# EAGLE schematic Resistor_Resistor (EAGLE 8.3.0), part 32 of 43
## Nets (continued)
N$53: R9001.2 R9002.2 R9003.2 R9004.2 R9005.2 R9006.2 R9007.2 R9008.2 R9009.2 R9010.2 R9011.2 R9012.2 R9013.2 R9014.2 R9015.2 R9016.2 R9017.2 R9018.2 R9019.2 R9020.2 R9021.2 R9022.2 R9023.2 R9024.2 R9025.2 R9026.2 R9027.2 R9028.2 R9029.2 R9030.2 R9031.2 R9032.2 R9033.2 R9034.2 R9035.2 R9036.2 R9037.2 R9038.2 R9039.2 R9040.2 R9041.2 R9042.2 R9043.2 R9044.2 R9045.2 R9046.2 R9047.2 R9048.2 R9049.2 R9050.2 R9051.2 R9052.2 R9053.2 R9054.2 R9055.2 R9056.2 R9057.2 R9058.2 R9059.2 R9060.2 R9061.2 R9062.2 R9063.2 R9064.2 R9065.2 R9066.2 R9067.2 R9068.2 R9069.2 R9070.2 R9071.2 R9072.2 R9073.2 R9074.2 R9075.2 R9076.2 R9077.2 R9078.2 R9079.2 R9080.2 R9081.2 R9082.2 R9083.2 R9084.2 R9085.2 R9086.2 R9087.2 R9088.2 R9089.2 R9090.2 R9091.2 R9092.2 R9093.2 R9094.2 R9095.2 R9096.2 R9097.2 R9098.2 R9099.2 R9100.2 R9101.2 R9102.2 R9103.2 R9104.2 R9105.2 R9106.2 R9107.2 R9108.2 R9109.2 R9110.2 R9111.2 R9112.2 R9113.2 R9114.2 R9115.2 R9116.2 R9117.2 R9118.2 R9119.2 R9120.2 R9121.2 R9122.2 R9123.2 R9124.2 R9125.2 R9126.2 R9127.2 R9128.2 R9129.2 R9130.2 R9131.2 R9132.2 R9133.2 R9134.2 R9135.2 R9136.2 R9137.2 R9138.2 R9139.2 R9140.2 R9141.2 R9142.2 R9143.2 R9144.2 R9145.2 R9146.2 R9147.2 R9148.2 R9149.2 R9150.2 R9151.2 R9152.2 R9153.2 R9154.2 R9155.2 R9156.2 R9157.2 R9158.2 R9159.2 R9160.2 R9161.2 R9162.2 R9163.2 R9164.2 R9165.2 R9166.2 R9167.2 R9168.2 R9169.2 R9170.2 R9171.2 R9172.2 R9173.2 R9174.2 R9175.2 R9176.2 R9177.2 R9178.2 R9179.2 R9180.2 R9181.2 R9182.2 R9183.2 R9184.2 R9185.2 R9186.2 R9187.2 R9188.2 R9189.2 R9190.2 R9191.2 R9192.2 R9193.2 R9194.2 R9195.2 R9196.2 R9197.2 R9198.2 R9199.2 R9200.2 R9201.1 R9202.1 R9203.1 R9204.1 R9205.1 R9206.1 R9207.1 R9208.1 R9209.1 R9210.1 R9211.1 R9212.1 R9213.1 R9214.1 R9215.1 R9216.1 R9217.1 R9218.1 R9219.1 R9220.1 R9221.1 R9222.1 R9223.1 R9224.1 R9225.1 R9226.1 R9227.1 R9228.1 R9229.1 R9230.1 R9231.1 R9232.1 R9233.1 R9234.1 R9235.1 R9236.1 R9237.1 R9238.1 R9239.1 R9240.1 R9241.1 R9242.1 R9243.1 R9244.1 R9245.1 R9246.1 R9247.1 R9248.1 R9249.1 R9250.1 R9251.1 R9252.1 R9253.1 R9254.1 R9255.1 R9256.1 R9257.1 R9258.1 R9259.1 R9260.1 R9261.1 R9262.1 R9263.1 R9264.1 R9265.1 R9266.1 R9267.1 R9268.1 R9269.1 R9270.1 R9271.1 R9272.1 R9273.1 R9274.1 R9275.1 R9276.1 R9277.1 R9278.1 R9279.1 R9280.1 R9281.1 R9282.1 R9283.1 R9284.1 R9285.1 R9286.1 R9287.1 R9288.1 R9289.1 R9290.1 R9291.1 R9292.1 R9293.1 R9294.1 R9295.1 R9296.1 R9297.1 R9298.1 R9299.1 R9300.1 R9301.1 R9302.1 R9303.1 R9304.1 R9305.1 R9306.1 R9307.1 R9308.1 R9309.1 R9310.1 R9311.1 R9312.1 R9313.1 R9314.1 R9315.1 R9316.1 R9317.1 R9318.1 R9319.1 R9320.1 R9321.1 R9322.1 R9323.1 R9324.1 R9325.1 R9326.1 R9327.1 R9328.1 R9329.1 R9330.1 R9331.1 R9332.1 R9333.1 R9334.1 R9335.1 R9336.1 R9337.1 R9338.1 R9339.1 R9340.1 R9341.1 R9342.1 R9343.1 R9344.1 R9345.1 R9346.1 R9347.1 R9348.1 R9349.1 R9350.1 R9351.1 R9352.1 R9353.1 R9354.1 R9355.1 R9356.1 R9357.1 R9358.1 R9359.1 R9360.1 R9361.1 R9362.1 R9363.1 R9364.1 R9365.1 R9366.1 R9367.1 R9368.1 R9369.1 R9370.1 R9371.1 R9372.1 R9373.1 R9374.1 R9375.1 R9376.1 R9377.1 R9378.1 R9379.1 R9380.1 R9381.1 R9382.1 R9383.1 R9384.1 R9385.1 R9386.1 R9387.1 R9388.1 R9389.1 R9390.1 R9391.1 R9392.1 R9393.1 R9394.1 R9395.1 R9396.1 R9397.1 R9398.1 R9399.1 R9400.1
N$54: R9201.2 R9202.2 R9203.2 R9204.2 R9205.2 R9206.2 R9207.2 R9208.2 R9209.2 R9210.2 R9211.2 R9212.2 R9213.2 R9214.2 R9215.2 R9216.2 R9217.2 R9218.2 R9219.2 R9220.2 R9221.2 R9222.2 R9223.2 R9224.2 R9225.2 R9226.2 R9227.2 R9228.2 R9229.2 R9230.2 R9231.2 R9232.2 R9233.2 R9234.2 R9235.2 R9236.2 R9237.2 R9238.2 R9239.2 R9240.2 R9241.2 R9242.2 R9243.2 R9244.2 R9245.2 R9246.2 R9247.2 R9248.2 R9249.2 R9250.2 R9251.2 R9252.2 R9253.2 R9254.2 R9255.2 R9256.2 R9257.2 R9258.2 R9259.2 R9260.2 R9261.2 R9262.2 R9263.2 R9264.2 R9265.2 R9266.2 R9267.2 R9268.2 R9269.2 R9270.2 R9271.2 R9272.2 R9273.2 R9274.2 R9275.2 R9276.2 R9277.2 R9278.2 R9279.2 R9280.2 R9281.2 R9282.2 R9283.2 R9284.2 R9285.2 R9286.2 R9287.2 R9288.2 R9289.2 R9290.2 R9291.2 R9292.2 R9293.2 R9294.2 R9295.2 R9296.2 R9297.2 R9298.2 R9299.2 R9300.2 R9301.2 R9302.2 R9303.2 R9304.2 R9305.2 R9306.2 R9307.2 R9308.2 R9309.2 R9310.2 R9311.2 R9312.2 R9313.2 R9314.2 R9315.2 R9316.2 R9317.2 R9318.2 R9319.2 R9320.2 R9321.2 R9322.2 R9323.2 R9324.2 R9325.2 R9326.2 R9327.2 R9328.2 R9329.2 R9330.2 R9331.2 R9332.2 R9333.2 R9334.2 R9335.2 R9336.2 R9337.2 R9338.2 R9339.2 R9340.2 R9341.2 R9342.2 R9343.2 R9344.2 R9345.2 R9346.2 R9347.2 R9348.2 R9349.2 R9350.2 R9351.2 R9352.2 R9353.2 R9354.2 R9355.2 R9356.2 R9357.2 R9358.2 R9359.2 R9360.2 R9361.2 R9362.2 R9363.2 R9364.2 R9365.2 R9366.2 R9367.2 R9368.2 R9369.2 R9370.2 R9371.2 R9372.2 R9373.2 R9374.2 R9375.2 R9376.2 R9377.2 R9378.2 R9379.2 R9380.2 R9381.2 R9382.2 R9383.2 R9384.2 R9385.2 R9386.2 R9387.2 R9388.2 R9389.2 R9390.2 R9391.2 R9392.2 R9393.2 R9394.2 R9395.2 R9396.2 R9397.2 R9398.2 R9399.2 R9400.2 R9401.1 R9402.1 R9403.1 R9404.1 R9405.1 R9406.1 R9407.1 R9408.1 R9409.1 R9410.1 R9411.1 R9412.1 R9413.1 R9414.1 R9415.1 R9416.1 R9417.1 R9418.1 R9419.1 R9420.1 R9421.1 R9422.1 R9423.1 R9424.1 R9425.1 R9426.1 R9427.1 R9428.1 R9429.1 R9430.1 R9431.1 R9432.1 R9433.1 R9434.1 R9435.1 R9436.1 R9437.1 R9438.1 R9439.1 R9440.1 R9441.1 R9442.1 R9443.1 R9444.1 R9445.1 R9446.1 R9447.1 R9448.1 R9449.1 R9450.1 R9451.1 R9452.1 R9453.1 R9454.1 R9455.1 R9456.1 R9457.1 R9458.1 R9459.1 R9460.1 R9461.1 R9462.1 R9463.1 R9464.1 R9465.1 R9466.1 R9467.1 R9468.1 R9469.1 R9470.1 R9471.1 R9472.1 R9473.1 R9474.1 R9475.1 R9476.1 R9477.1 R9478.1 R9479.1 R9480.1 R9481.1 R9482.1 R9483.1 R9484.1 R9485.1 R9486.1 R9487.1 R9488.1 R9489.1 R9490.1 R9491.1 R9492.1 R9493.1 R9494.1 R9495.1 R9496.1 R9497.1 R9498.1 R9499.1 R9500.1 R9501.1 R9502.1 R9503.1 R9504.1 R9505.1 R9506.1 R9507.1 R9508.1 R9509.1 R9510.1 R9511.1 R9512.1 R9513.1 R9514.1 R9515.1 R9516.1 R9517.1 R9518.1 R9519.1 R9520.1 R9521.1 R9522.1 R9523.1 R9524.1 R9525.1 R9526.1 R9527.1 R9528.1 R9529.1 R9530.1 R9531.1 R9532.1 R9533.1 R9534.1 R9535.1 R9536.1 R9537.1 R9538.1 R9539.1 R9540.1 R9541.1 R9542.1 R9543.1 R9544.1 R9545.1 R9546.1 R9547.1 R9548.1 R9549.1 R9550.1 R9551.1 R9552.1 R9553.1 R9554.1 R9555.1 R9556.1 R9557.1 R9558.1 R9559.1 R9560.1 R9561.1 R9562.1 R9563.1 R9564.1 R9565.1 R9566.1 R9567.1 R9568.1 R9569.1 R9570.1 R9571.1 R9572.1 R9573.1 R9574.1 R9575.1 R9576.1 R9577.1 R9578.1 R9579.1 R9580.1 R9581.1 R9582.1 R9583.1 R9584.1 R9585.1 R9586.1 R9587.1 R9588.1 R9589.1 R9590.1 R9591.1 R9592.1 R9593.1 R9594.1 R9595.1 R9596.1 R9597.1 R9598.1 R9599.1 R9600.1
N$55: R9401.2 R9402.2 R9403.2 R9404.2 R9405.2 R9406.2 R9407.2 R9408.2 R9409.2 R9410.2 R9411.2 R9412.2 R9413.2 R9414.2 R9415.2 R9416.2 R9417.2 R9418.2 R9419.2 R9420.2 R9421.2 R9422.2 R9423.2 R9424.2 R9425.2 R9426.2 R9427.2 R9428.2 R9429.2 R9430.2 R9431.2 R9432.2 R9433.2 R9434.2 R9435.2 R9436.2 R9437.2 R9438.2 R9439.2 R9440.2 R9441.2 R9442.2 R9443.2 R9444.2 R9445.2 R9446.2 R9447.2 R9448.2 R9449.2 R9450.2 R9451.2 R9452.2 R9453.2 R9454.2 R9455.2 R9456.2 R9457.2 R9458.2 R9459.2 R9460.2 R9461.2 R9462.2 R9463.2 R9464.2 R9465.2 R9466.2 R9467.2 R9468.2 R9469.2 R9470.2 R9471.2 R9472.2 R9473.2 R9474.2 R9475.2 R9476.2 R9477.2 R9478.2 R9479.2 R9480.2 R9481.2 R9482.2 R9483.2 R9484.2 R9485.2 R9486.2 R9487.2 R9488.2 R9489.2 R9490.2 R9491.2 R9492.2 R9493.2 R9494.2 R9495.2 R9496.2 R9497.2 R9498.2 R9499.2 R9500.2 R9501.2 R9502.2 R9503.2 R9504.2 R9505.2 R9506.2 R9507.2 R9508.2 R9509.2 R9510.2 R9511.2 R9512.2 R9513.2 R9514.2 R9515.2 R9516.2 R9517.2 R9518.2 R9519.2 R9520.2 R9521.2 R9522.2 R9523.2 R9524.2 R9525.2 R9526.2 R9527.2 R9528.2 R9529.2 R9530.2 R9531.2 R9532.2 R9533.2 R9534.2 R9535.2 R9536.2 R9537.2 R9538.2 R9539.2 R9540.2 R9541.2 R9542.2 R9543.2 R9544.2 R9545.2 R9546.2 R9547.2 R9548.2 R9549.2 R9550.2 R9551.2 R9552.2 R9553.2 R9554.2 R9555.2 R9556.2 R9557.2 R9558.2 R9559.2 R9560.2 R9561.2 R9562.2 R9563.2 R9564.2 R9565.2 R9566.2 R9567.2 R9568.2 R9569.2 R9570.2 R9571.2 R9572.2 R9573.2 R9574.2 R9575.2 R9576.2 R9577.2 R9578.2 R9579.2 R9580.2 R9581.2 R9582.2 R9583.2 R9584.2 R9585.2 R9586.2 R9587.2 R9588.2 R9589.2 R9590.2 R9591.2 R9592.2 R9593.2 R9594.2 R9595.2 R9596.2 R9597.2 R9598.2 R9599.2 R9600.2 R9601.1 R9602.1 R9603.1 R9604.1 R9605.1 R9606.1 R9607.1 R9608.1 R9609.1 R9610.1 R9611.1 R9612.1 R9613.1 R9614.1 R9615.1 R9616.1 R9617.1 R9618.1 R9619.1 R9620.1 R9621.1 R9622.1 R9623.1 R9624.1 R9625.1 R9626.1 R9627.1 R9628.1 R9629.1 R9630.1 R9631.1 R9632.1 R9633.1 R9634.1 R9635.1 R9636.1 R9637.1 R9638.1 R9639.1 R9640.1 R9641.1 R9642.1 R9643.1 R9644.1 R9645.1 R9646.1 R9647.1 R9648.1 R9649.1 R9650.1 R9651.1 R9652.1 R9653.1 R9654.1 R9655.1 R9656.1 R9657.1 R9658.1 R9659.1 R9660.1 R9661.1 R9662.1 R9663.1 R9664.1 R9665.1 R9666.1 R9667.1 R9668.1 R9669.1 R9670.1 R9671.1 R9672.1 R9673.1 R9674.1 R9675.1 R9676.1 R9677.1 R9678.1 R9679.1 R9680.1 R9681.1 R9682.1 R9683.1 R9684.1 R9685.1 R9686.1 R9687.1 R9688.1 R9689.1 R9690.1 R9691.1 R9692.1 R9693.1 R9694.1 R9695.1 R9696.1 R9697.1 R9698.1 R9699.1 R9700.1 R9701.1 R9702.1 R9703.1 R9704.1 R9705.1 R9706.1 R9707.1 R9708.1 R9709.1 R9710.1 R9711.1 R9712.1 R9713.1 R9714.1 R9715.1 R9716.1 R9717.1 R9718.1 R9719.1 R9720.1 R9721.1 R9722.1 R9723.1 R9724.1 R9725.1 R9726.1 R9727.1 R9728.1 R9729.1 R9730.1 R9731.1 R9732.1 R9733.1 R9734.1 R9735.1 R9736.1 R9737.1 R9738.1 R9739.1 R9740.1 R9741.1 R9742.1 R9743.1 R9744.1 R9745.1 R9746.1 R9747.1 R9748.1 R9749.1 R9750.1 R9751.1 R9752.1 R9753.1 R9754.1 R9755.1 R9756.1 R9757.1 R9758.1 R9759.1 R9760.1 R9761.1 R9762.1 R9763.1 R9764.1 R9765.1 R9766.1 R9767.1 R9768.1 R9769.1 R9770.1 R9771.1 R9772.1 R9773.1 R9774.1 R9775.1 R9776.1 R9777.1 R9778.1 R9779.1 R9780.1 R9781.1 R9782.1 R9783.1 R9784.1 R9785.1 R9786.1 R9787.1 R9788.1 R9789.1 R9790.1 R9791.1 R9792.1 R9793.1 R9794.1 R9795.1 R9796.1 R9797.1 R9798.1 R9799.1 R9800.1
N$56: R9601.2 R9602.2 R9603.2 R9604.2 R9605.2 R9606.2 R9607.2 R9608.2 R9609.2 R9610.2 R9611.2 R9612.2 R9613.2 R9614.2 R9615.2 R9616.2 R9617.2 R9618.2 R9619.2 R9620.2 R9621.2 R9622.2 R9623.2 R9624.2 R9625.2 R9626.2 R9627.2 R9628.2 R9629.2 R9630.2 R9631.2 R9632.2 R9633.2 R9634.2 R9635.2 R9636.2 R9637.2 R9638.2 R9639.2 R9640.2 R9641.2 R9642.2 R9643.2 R9644.2 R9645.2 R9646.2 R9647.2 R9648.2 R9649.2 R9650.2 R9651.2 R9652.2 R9653.2 R9654.2 R9655.2 R9656.2 R9657.2 R9658.2 R9659.2 R9660.2 R9661.2 R9662.2 R9663.2 R9664.2 R9665.2 R9666.2 R9667.2 R9668.2 R9669.2 R9670.2 R9671.2 R9672.2 R9673.2 R9674.2 R9675.2 R9676.2 R9677.2 R9678.2 R9679.2 R9680.2 R9681.2 R9682.2 R9683.2 R9684.2 R9685.2 R9686.2 R9687.2 R9688.2 R9689.2 R9690.2 R9691.2 R9692.2 R9693.2 R9694.2 R9695.2 R9696.2 R9697.2 R9698.2 R9699.2 R9700.2 R9701.2 R9702.2 R9703.2 R9704.2 R9705.2 R9706.2 R9707.2 R9708.2 R9709.2 R9710.2 R9711.2 R9712.2 R9713.2 R9714.2 R9715.2 R9716.2 R9717.2 R9718.2 R9719.2 R9720.2 R9721.2 R9722.2 R9723.2 R9724.2 R9725.2 R9726.2 R9727.2 R9728.2 R9729.2 R9730.2 R9731.2 R9732.2 R9733.2 R9734.2 R9735.2 R9736.2 R9737.2 R9738.2 R9739.2 R9740.2 R9741.2 R9742.2 R9743.2 R9744.2 R9745.2 R9746.2 R9747.2 R9748.2 R9749.2 R9750.2 R9751.2 R9752.2 R9753.2 R9754.2 R9755.2 R9756.2 R9757.2 R9758.2 R9759.2 R9760.2 R9761.2 R9762.2 R9763.2 R9764.2 R9765.2 R9766.2 R9767.2 R9768.2 R9769.2 R9770.2 R9771.2 R9772.2 R9773.2 R9774.2 R9775.2 R9776.2 R9777.2 R9778.2 R9779.2 R9780.2 R9781.2 R9782.2 R9783.2 R9784.2 R9785.2 R9786.2 R9787.2 R9788.2 R9789.2 R9790.2 R9791.2 R9792.2 R9793.2 R9794.2 R9795.2 R9796.2 R9797.2 R9798.2 R9799.2 R9800.2 R9801.1 R9802.1 R9803.1 R9804.1 R9805.1 R9806.1 R9807.1 R9808.1 R9809.1 R9810.1 R9811.1 R9812.1 R9813.1 R9814.1 R9815.1 R9816.1 R9817.1 R9818.1 R9819.1 R9820.1 R9821.1 R9822.1 R9823.1 R9824.1 R9825.1 R9826.1 R9827.1 R9828.1 R9829.1 R9830.1 R9831.1 R9832.1 R9833.1 R9834.1 R9835.1 R9836.1 R9837.1 R9838.1 R9839.1 R9840.1 R9841.1 R9842.1 R9843.1 R9844.1 R9845.1 R9846.1 R9847.1 R9848.1 R9849.1 R9850.1 R9851.1 R9852.1 R9853.1 R9854.1 R9855.1 R9856.1 R9857.1 R9858.1 R9859.1 R9860.1 R9861.1 R9862.1 R9863.1 R9864.1 R9865.1 R9866.1 R9867.1 R9868.1 R9869.1 R9870.1 R9871.1 R9872.1 R9873.1 R9874.1 R9875.1 R9876.1 R9877.1 R9878.1 R9879.1 R9880.1 R9881.1 R9882.1 R9883.1 R9884.1 R9885.1 R9886.1 R9887.1 R9888.1 R9889.1 R9890.1 R9891.1 R9892.1 R9893.1 R9894.1 R9895.1 R9896.1 R9897.1 R9898.1 R9899.1 R9900.1 R9901.1 R9902.1 R9903.1 R9904.1 R9905.1 R9906.1 R9907.1 R9908.1 R9909.1 R9910.1 R9911.1 R9912.1 R9913.1 R9914.1 R9915.1 R9916.1 R9917.1 R9918.1 R9919.1 R9920.1 R9921.1 R9922.1 R9923.1 R9924.1 R9925.1 R9926.1 R9927.1 R9928.1 R9929.1 R9930.1 R9931.1 R9932.1 R9933.1 R9934.1 R9935.1 R9936.1 R9937.1 R9938.1 R9939.1 R9940.1 R9941.1 R9942.1 R9943.1 R9944.1 R9945.1 R9946.1 R9947.1 R9948.1 R9949.1 R9950.1 R9951.1 R9952.1 R9953.1 R9954.1 R9955.1 R9956.1 R9957.1 R9958.1 R9959.1 R9960.1 R9961.1 R9962.1 R9963.1 R9964.1 R9965.1 R9966.1 R9967.1 R9968.1 R9969.1 R9970.1 R9971.1 R9972.1 R9973.1 R9974.1 R9975.1 R9976.1 R9977.1 R9978.1 R9979.1 R9980.1 R9981.1 R9982.1 R9983.1 R9984.1 R9985.1 R9986.1 R9987.1 R9988.1 R9989.1 R9990.1 R9991.1 R9992.1 R9993.1 R9994.1 R9995.1 R9996.1 R9997.1 R9998.1 R9999.1 R10000.1
N$57: R9801.2 R9802.2 R9803.2 R9804.2 R9805.2 R9806.2 R9807.2 R9808.2 R9809.2 R9810.2 R9811.2 R9812.2 R9813.2 R9814.2 R9815.2 R9816.2 R9817.2 R9818.2 R9819.2 R9820.2 R9821.2 R9822.2 R9823.2 R9824.2 R9825.2 R9826.2 R9827.2 R9828.2 R9829.2 R9830.2 R9831.2 R9832.2 R9833.2 R9834.2 R9835.2 R9836.2 R9837.2 R9838.2 R9839.2 R9840.2 R9841.2 R9842.2 R9843.2 R9844.2 R9845.2 R9846.2 R9847.2 R9848.2 R9849.2 R9850.2 R9851.2 R9852.2 R9853.2 R9854.2 R9855.2 R9856.2 R9857.2 R9858.2 R9859.2 R9860.2 R9861.2 R9862.2 R9863.2 R9864.2 R9865.2 R9866.2 R9867.2 R9868.2 R9869.2 R9870.2 R9871.2 R9872.2 R9873.2 R9874.2 R9875.2 R9876.2 R9877.2 R9878.2 R9879.2 R9880.2 R9881.2 R9882.2 R9883.2 R9884.2 R9885.2 R9886.2 R9887.2 R9888.2 R9889.2 R9890.2 R9891.2 R9892.2 R9893.2 R9894.2 R9895.2 R9896.2 R9897.2 R9898.2 R9899.2 R9900.2 R9901.2 R9902.2 R9903.2 R9904.2 R9905.2 R9906.2 R9907.2 R9908.2 R9909.2 R9910.2 R9911.2 R9912.2 R9913.2 R9914.2 R9915.2 R9916.2 R9917.2 R9918.2 R9919.2 R9920.2 R9921.2 R9922.2 R9923.2 R9924.2 R9925.2 R9926.2 R9927.2 R9928.2 R9929.2 R9930.2 R9931.2 R9932.2 R9933.2 R9934.2 R9935.2 R9936.2 R9937.2 R9938.2 R9939.2 R9940.2 R9941.2 R9942.2 R9943.2 R9944.2 R9945.2 R9946.2 R9947.2 R9948.2 R9949.2 R9950.2 R9951.2 R9952.2 R9953.2 R9954.2 R9955.2 R9956.2 R9957.2 R9958.2 R9959.2 R9960.2 R9961.2 R9962.2 R9963.2 R9964.2 R9965.2 R9966.2 R9967.2 R9968.2 R9969.2 R9970.2 R9971.2 R9972.2 R9973.2 R9974.2 R9975.2 R9976.2 R9977.2 R9978.2 R9979.2 R9980.2 R9981.2 R9982.2 R9983.2 R9984.2 R9985.2 R9986.2 R9987.2 R9988.2 R9989.2 R9990.2 R9991.2 R9992.2 R9993.2 R9994.2 R9995.2 R9996.2 R9997.2 R9998.2 R9999.2 R10000.2 R10001.1 R10002.1 R10003.1 R10004.1 R10005.1 R10006.1 R10007.1 R10008.1 R10009.1 R10010.1 R10011.1 R10012.1 R10013.1 R10014.1 R10015.1 R10016.1 R10017.1 R10018.1 R10019.1 R10020.1 R10021.1 R10022.1 R10023.1 R10024.1 R10025.1 R10026.1 R10027.1 R10028.1 R10029.1 R10030.1 R10031.1 R10032.1 R10033.1 R10034.1 R10035.1 R10036.1 R10037.1 R10038.1 R10039.1 R10040.1 R10041.1 R10042.1 R10043.1 R10044.1 R10045.1 R10046.1 R10047.1 R10048.1 R10049.1 R10050.1 R10051.1 R10052.1 R10053.1 R10054.1 R10055.1 R10056.1 R10057.1 R10058.1 R10059.1 R10060.1 R10061.1 R10062.1 R10063.1 R10064.1 R10065.1 R10066.1 R10067.1 R10068.1 R10069.1 R10070.1 R10071.1 R10072.1 R10073.1 R10074.1 R10075.1 R10076.1 R10077.1 R10078.1 R10079.1 R10080.1 R10081.1 R10082.1 R10083.1 R10084.1 R10085.1 R10086.1 R10087.1 R10088.1 R10089.1 R10090.1 R10091.1 R10092.1 R10093.1 R10094.1 R10095.1 R10096.1 R10097.1 R10098.1 R10099.1 R10100.1 R10101.1 R10102.1 R10103.1 R10104.1 R10105.1 R10106.1 R10107.1 R10108.1 R10109.1 R10110.1 R10111.1 R10112.1 R10113.1 R10114.1 R10115.1 R10116.1 R10117.1 R10118.1 R10119.1 R10120.1 R10121.1 R10122.1 R10123.1 R10124.1 R10125.1 R10126.1 R10127.1 R10128.1 R10129.1 R10130.1 R10131.1 R10132.1 R10133.1 R10134.1 R10135.1 R10136.1 R10137.1 R10138.1 R10139.1 R10140.1 R10141.1 R10142.1 R10143.1 R10144.1 R10145.1 R10146.1 R10147.1 R10148.1 R10149.1 R10150.1 R10151.1 R10152.1 R10153.1 R10154.1 R10155.1 R10156.1 R10157.1 R10158.1 R10159.1 R10160.1 R10161.1 R10162.1 R10163.1 R10164.1 R10165.1 R10166.1 R10167.1 R10168.1 R10169.1 R10170.1 R10171.1 R10172.1 R10173.1 R10174.1 R10175.1 R10176.1 R10177.1 R10178.1 R10179.1 R10180.1 R10181.1 R10182.1 R10183.1 R10184.1 R10185.1 R10186.1 R10187.1 R10188.1 R10189.1 R10190.1 R10191.1 R10192.1 R10193.1 R10194.1 R10195.1 R10196.1 R10197.1 R10198.1 R10199.1 R10200.1
N$58: R10001.2 R10002.2 R10003.2 R10004.2 R10005.2 R10006.2 R10007.2 R10008.2 R10009.2 R10010.2 R10011.2 R10012.2 R10013.2 R10014.2 R10015.2 R10016.2 R10017.2 R10018.2 R10019.2 R10020.2 R10021.2 R10022.2 R10023.2 R10024.2 R10025.2 R10026.2 R10027.2 R10028.2 R10029.2 R10030.2 R10031.2 R10032.2 R10033.2 R10034.2 R10035.2 R10036.2 R10037.2 R10038.2 R10039.2 R10040.2 R10041.2 R10042.2 R10043.2 R10044.2 R10045.2 R10046.2 R10047.2 R10048.2 R10049.2 R10050.2 R10051.2 R10052.2 R10053.2 R10054.2 R10055.2 R10056.2 R10057.2 R10058.2 R10059.2 R10060.2 R10061.2 R10062.2 R10063.2 R10064.2 R10065.2 R10066.2 R10067.2 R10068.2 R10069.2 R10070.2 R10071.2 R10072.2 R10073.2 R10074.2 R10075.2 R10076.2 R10077.2 R10078.2 R10079.2 R10080.2 R10081.2 R10082.2 R10083.2 R10084.2 R10085.2 R10086.2 R10087.2 R10088.2 R10089.2 R10090.2 R10091.2 R10092.2 R10093.2 R10094.2 R10095.2 R10096.2 R10097.2 R10098.2 R10099.2 R10100.2 R10101.2 R10102.2 R10103.2 R10104.2 R10105.2 R10106.2 R10107.2 R10108.2 R10109.2 R10110.2 R10111.2 R10112.2 R10113.2 R10114.2 R10115.2 R10116.2 R10117.2 R10118.2 R10119.2 R10120.2 R10121.2 R10122.2 R10123.2 R10124.2 R10125.2 R10126.2 R10127.2 R10128.2 R10129.2 R10130.2 R10131.2 R10132.2 R10133.2 R10134.2 R10135.2 R10136.2 R10137.2 R10138.2 R10139.2 R10140.2 R10141.2 R10142.2 R10143.2 R10144.2 R10145.2 R10146.2 R10147.2 R10148.2 R10149.2 R10150.2 R10151.2 R10152.2 R10153.2 R10154.2 R10155.2 R10156.2 R10157.2 R10158.2 R10159.2 R10160.2 R10161.2 R10162.2 R10163.2 R10164.2 R10165.2 R10166.2 R10167.2 R10168.2 R10169.2 R10170.2 R10171.2 R10172.2 R10173.2 R10174.2 R10175.2 R10176.2 R10177.2 R10178.2 R10179.2 R10180.2 R10181.2 R10182.2 R10183.2 R10184.2 R10185.2 R10186.2 R10187.2 R10188.2 R10189.2 R10190.2 R10191.2 R10192.2 R10193.2 R10194.2 R10195.2 R10196.2 R10197.2 R10198.2 R10199.2 R10200.2 R10201.1 R10202.1 R10203.1 R10204.1 R10205.1 R10206.1 R10207.1 R10208.1 R10209.1 R10210.1 R10211.1 R10212.1 R10213.1 R10214.1 R10215.1 R10216.1 R10217.1 R10218.1 R10219.1 R10220.1 R10221.1 R10222.1 R10223.1 R10224.1 R10225.1 R10226.1 R10227.1 R10228.1 R10229.1 R10230.1 R10231.1 R10232.1 R10233.1 R10234.1 R10235.1 R10236.1 R10237.1 R10238.1 R10239.1 R10240.1 R10241.1 R10242.1 R10243.1 R10244.1 R10245.1 R10246.1 R10247.1 R10248.1 R10249.1 R10250.1 R10251.1 R10252.1 R10253.1 R10254.1 R10255.1 R10256.1 R10257.1 R10258.1 R10259.1 R10260.1 R10261.1 R10262.1 R10263.1 R10264.1 R10265.1 R10266.1 R10267.1 R10268.1 R10269.1 R10270.1 R10271.1 R10272.1 R10273.1 R10274.1 R10275.1 R10276.1 R10277.1 R10278.1 R10279.1 R10280.1 R10281.1 R10282.1 R10283.1 R10284.1 R10285.1 R10286.1 R10287.1 R10288.1 R10289.1 R10290.1 R10291.1 R10292.1 R10293.1 R10294.1 R10295.1 R10296.1 R10297.1 R10298.1 R10299.1 R10300.1 R10301.1 R10302.1 R10303.1 R10304.1 R10305.1 R10306.1 R10307.1 R10308.1 R10309.1 R10310.1 R10311.1 R10312.1 R10313.1 R10314.1 R10315.1 R10316.1 R10317.1 R10318.1 R10319.1 R10320.1 R10321.1 R10322.1 R10323.1 R10324.1 R10325.1 R10326.1 R10327.1 R10328.1 R10329.1 R10330.1 R10331.1 R10332.1 R10333.1 R10334.1 R10335.1 R10336.1 R10337.1 R10338.1 R10339.1 R10340.1 R10341.1 R10342.1 R10343.1 R10344.1 R10345.1 R10346.1 R10347.1 R10348.1 R10349.1 R10350.1 R10351.1 R10352.1 R10353.1 R10354.1 R10355.1 R10356.1 R10357.1 R10358.1 R10359.1 R10360.1 R10361.1 R10362.1 R10363.1 R10364.1 R10365.1 R10366.1 R10367.1 R10368.1 R10369.1 R10370.1 R10371.1 R10372.1 R10373.1 R10374.1 R10375.1 R10376.1 R10377.1 R10378.1 R10379.1 R10380.1 R10381.1 R10382.1 R10383.1 R10384.1 R10385.1 R10386.1 R10387.1 R10388.1 R10389.1 R10390.1 R10391.1 R10392.1 R10393.1 R10394.1 R10395.1 R10396.1 R10397.1 R10398.1 R10399.1 R10400.1
N$59: R10201.2 R10202.2 R10203.2 R10204.2 R10205.2 R10206.2 R10207.2 R10208.2 R10209.2 R10210.2 R10211.2 R10212.2 R10213.2 R10214.2 R10215.2 R10216.2 R10217.2 R10218.2 R10219.2 R10220.2 R10221.2 R10222.2 R10223.2 R10224.2 R10225.2 R10226.2 R10227.2 R10228.2 R10229.2 R10230.2 R10231.2 R10232.2 R10233.2 R10234.2 R10235.2 R10236.2 R10237.2 R10238.2 R10239.2 R10240.2 R10241.2 R10242.2 R10243.2 R10244.2 R10245.2 R10246.2 R10247.2 R10248.2 R10249.2 R10250.2 R10251.2 R10252.2 R10253.2 R10254.2 R10255.2 R10256.2 R10257.2 R10258.2 R10259.2 R10260.2 R10261.2 R10262.2 R10263.2 R10264.2 R10265.2 R10266.2 R10267.2 R10268.2 R10269.2 R10270.2 R10271.2 R10272.2 R10273.2 R10274.2 R10275.2 R10276.2 R10277.2 R10278.2 R10279.2 R10280.2 R10281.2 R10282.2 R10283.2 R10284.2 R10285.2 R10286.2 R10287.2 R10288.2 R10289.2 R10290.2 R10291.2 R10292.2 R10293.2 R10294.2 R10295.2 R10296.2 R10297.2 R10298.2 R10299.2 R10300.2 R10301.2 R10302.2 R10303.2 R10304.2 R10305.2 R10306.2 R10307.2 R10308.2 R10309.2 R10310.2 R10311.2 R10312.2 R10313.2 R10314.2 R10315.2 R10316.2 R10317.2 R10318.2 R10319.2 R10320.2 R10321.2 R10322.2 R10323.2 R10324.2 R10325.2 R10326.2 R10327.2 R10328.2 R10329.2 R10330.2 R10331.2 R10332.2 R10333.2 R10334.2 R10335.2 R10336.2 R10337.2 R10338.2 R10339.2 R10340.2 R10341.2 R10342.2 R10343.2 R10344.2 R10345.2 R10346.2 R10347.2 R10348.2 R10349.2 R10350.2 R10351.2 R10352.2 R10353.2 R10354.2 R10355.2 R10356.2 R10357.2 R10358.2 R10359.2 R10360.2 R10361.2 R10362.2 R10363.2 R10364.2 R10365.2 R10366.2 R10367.2 R10368.2 R10369.2 R10370.2 R10371.2 R10372.2 R10373.2 R10374.2 R10375.2 R10376.2 R10377.2 R10378.2 R10379.2 R10380.2 R10381.2 R10382.2 R10383.2 R10384.2 R10385.2 R10386.2 R10387.2 R10388.2 R10389.2 R10390.2 R10391.2 R10392.2 R10393.2 R10394.2 R10395.2 R10396.2 R10397.2 R10398.2 R10399.2 R10400.2 R10401.1 R10402.1 R10403.1 R10404.1 R10405.1 R10406.1 R10407.1 R10408.1 R10409.1 R10410.1 R10411.1 R10412.1 R10413.1 R10414.1 R10415.1 R10416.1 R10417.1 R10418.1 R10419.1 R10420.1 R10421.1 R10422.1 R10423.1 R10424.1 R10425.1 R10426.1 R10427.1 R10428.1 R10429.1 R10430.1 R10431.1 R10432.1 R10433.1 R10434.1 R10435.1 R10436.1 R10437.1 R10438.1 R10439.1 R10440.1 R10441.1 R10442.1 R10443.1 R10444.1 R10445.1 R10446.1 R10447.1 R10448.1 R10449.1 R10450.1 R10451.1 R10452.1 R10453.1 R10454.1 R10455.1 R10456.1 R10457.1 R10458.1 R10459.1 R10460.1 R10461.1 R10462.1 R10463.1 R10464.1 R10465.1 R10466.1 R10467.1 R10468.1 R10469.1 R10470.1 R10471.1 R10472.1 R10473.1 R10474.1 R10475.1 R10476.1 R10477.1 R10478.1 R10479.1 R10480.1 R10481.1 R10482.1 R10483.1 R10484.1 R10485.1 R10486.1 R10487.1 R10488.1 R10489.1 R10490.1 R10491.1 R10492.1 R10493.1 R10494.1 R10495.1 R10496.1 R10497.1 R10498.1 R10499.1 R10500.1 R10501.1 R10502.1 R10503.1 R10504.1 R10505.1 R10506.1 R10507.1 R10508.1 R10509.1 R10510.1 R10511.1 R10512.1 R10513.1 R10514.1 R10515.1 R10516.1 R10517.1 R10518.1 R10519.1 R10520.1 R10521.1 R10522.1 R10523.1 R10524.1 R10525.1 R10526.1 R10527.1 R10528.1 R10529.1 R10530.1 R10531.1 R10532.1 R10533.1 R10534.1 R10535.1 R10536.1 R10537.1 R10538.1 R10539.1 R10540.1 R10541.1 R10542.1 R10543.1 R10544.1 R10545.1 R10546.1 R10547.1 R10548.1 R10549.1 R10550.1 R10551.1 R10552.1 R10553.1 R10554.1 R10555.1 R10556.1 R10557.1 R10558.1 R10559.1 R10560.1 R10561.1 R10562.1 R10563.1 R10564.1 R10565.1 R10566.1 R10567.1 R10568.1 R10569.1 R10570.1 R10571.1 R10572.1 R10573.1 R10574.1 R10575.1 R10576.1 R10577.1 R10578.1 R10579.1 R10580.1 R10581.1 R10582.1 R10583.1 R10584.1 R10585.1 R10586.1 R10587.1 R10588.1 R10589.1 R10590.1 R10591.1 R10592.1 R10593.1 R10594.1 R10595.1 R10596.1 R10597.1 R10598.1 R10599.1 R10600.1
N$60: R10401.2 R10402.2 R10403.2 R10404.2 R10405.2 R10406.2 R10407.2 R10408.2 R10409.2 R10410.2 R10411.2 R10412.2 R10413.2 R10414.2 R10415.2 R10416.2 R10417.2 R10418.2 R10419.2 R10420.2 R10421.2 R10422.2 R10423.2 R10424.2 R10425.2 R10426.2 R10427.2 R10428.2 R10429.2 R10430.2 R10431.2 R10432.2 R10433.2 R10434.2 R10435.2 R10436.2 R10437.2 R10438.2 R10439.2 R10440.2 R10441.2 R10442.2 R10443.2 R10444.2 R10445.2 R10446.2 R10447.2 R10448.2 R10449.2 R10450.2 R10451.2 R10452.2 R10453.2 R10454.2 R10455.2 R10456.2 R10457.2 R10458.2 R10459.2 R10460.2 R10461.2 R10462.2 R10463.2 R10464.2 R10465.2 R10466.2 R10467.2 R10468.2 R10469.2 R10470.2 R10471.2 R10472.2 R10473.2 R10474.2 R10475.2 R10476.2 R10477.2 R10478.2 R10479.2 R10480.2 R10481.2 R10482.2 R10483.2 R10484.2 R10485.2 R10486.2 R10487.2 R10488.2 R10489.2 R10490.2 R10491.2 R10492.2 R10493.2 R10494.2 R10495.2 R10496.2 R10497.2 R10498.2 R10499.2 R10500.2 R10501.2 R10502.2 R10503.2 R10504.2 R10505.2 R10506.2 R10507.2 R10508.2 R10509.2 R10510.2 R10511.2 R10512.2 R10513.2 R10514.2 R10515.2 R10516.2 R10517.2 R10518.2 R10519.2 R10520.2 R10521.2 R10522.2 R10523.2 R10524.2 R10525.2 R10526.2 R10527.2 R10528.2 R10529.2 R10530.2 R10531.2 R10532.2 R10533.2 R10534.2 R10535.2 R10536.2 R10537.2 R10538.2 R10539.2 R10540.2 R10541.2 R10542.2 R10543.2 R10544.2 R10545.2 R10546.2 R10547.2 R10548.2 R10549.2 R10550.2 R10551.2 R10552.2 R10553.2 R10554.2 R10555.2 R10556.2 R10557.2 R10558.2 R10559.2 R10560.2 R10561.2 R10562.2 R10563.2 R10564.2 R10565.2 R10566.2 R10567.2 R10568.2 R10569.2 R10570.2 R10571.2 R10572.2 R10573.2 R10574.2 R10575.2 R10576.2 R10577.2 R10578.2 R10579.2 R10580.2 R10581.2 R10582.2 R10583.2 R10584.2 R10585.2 R10586.2 R10587.2 R10588.2 R10589.2 R10590.2 R10591.2 R10592.2 R10593.2 R10594.2 R10595.2 R10596.2 R10597.2 R10598.2 R10599.2 R10600.2 R10601.1 R10602.1 R10603.1 R10604.1 R10605.1 R10606.1 R10607.1 R10608.1 R10609.1 R10610.1 R10611.1 R10612.1 R10613.1 R10614.1 R10615.1 R10616.1 R10617.1 R10618.1 R10619.1 R10620.1 R10621.1 R10622.1 R10623.1 R10624.1 R10625.1 R10626.1 R10627.1 R10628.1 R10629.1 R10630.1 R10631.1 R10632.1 R10633.1 R10634.1 R10635.1 R10636.1 R10637.1 R10638.1 R10639.1 R10640.1 R10641.1 R10642.1 R10643.1 R10644.1 R10645.1 R10646.1 R10647.1 R10648.1 R10649.1 R10650.1 R10651.1 R10652.1 R10653.1 R10654.1 R10655.1 R10656.1 R10657.1 R10658.1 R10659.1 R10660.1 R10661.1 R10662.1 R10663.1 R10664.1 R10665.1 R10666.1 R10667.1 R10668.1 R10669.1 R10670.1 R10671.1 R10672.1 R10673.1 R10674.1 R10675.1 R10676.1 R10677.1 R10678.1 R10679.1 R10680.1 R10681.1 R10682.1 R10683.1 R10684.1 R10685.1 R10686.1 R10687.1 R10688.1 R10689.1 R10690.1 R10691.1 R10692.1 R10693.1 R10694.1 R10695.1 R10696.1 R10697.1 R10698.1 R10699.1 R10700.1 R10701.1 R10702.1 R10703.1 R10704.1 R10705.1 R10706.1 R10707.1 R10708.1 R10709.1 R10710.1 R10711.1 R10712.1 R10713.1 R10714.1 R10715.1 R10716.1 R10717.1 R10718.1 R10719.1 R10720.1 R10721.1 R10722.1 R10723.1 R10724.1 R10725.1 R10726.1 R10727.1 R10728.1 R10729.1 R10730.1 R10731.1 R10732.1 R10733.1 R10734.1 R10735.1 R10736.1 R10737.1 R10738.1 R10739.1 R10740.1 R10741.1 R10742.1 R10743.1 R10744.1 R10745.1 R10746.1 R10747.1 R10748.1 R10749.1 R10750.1 R10751.1 R10752.1 R10753.1 R10754.1 R10755.1 R10756.1 R10757.1 R10758.1 R10759.1 R10760.1 R10761.1 R10762.1 R10763.1 R10764.1 R10765.1 R10766.1 R10767.1 R10768.1 R10769.1 R10770.1 R10771.1 R10772.1 R10773.1 R10774.1 R10775.1 R10776.1 R10777.1 R10778.1 R10779.1 R10780.1 R10781.1 R10782.1 R10783.1 R10784.1 R10785.1 R10786.1 R10787.1 R10788.1 R10789.1 R10790.1 R10791.1 R10792.1 R10793.1 R10794.1 R10795.1 R10796.1 R10797.1 R10798.1 R10799.1 R10800.1